# EAGLE design MCS (EAGLE 7.5.0)

## Sheet 1 of 2
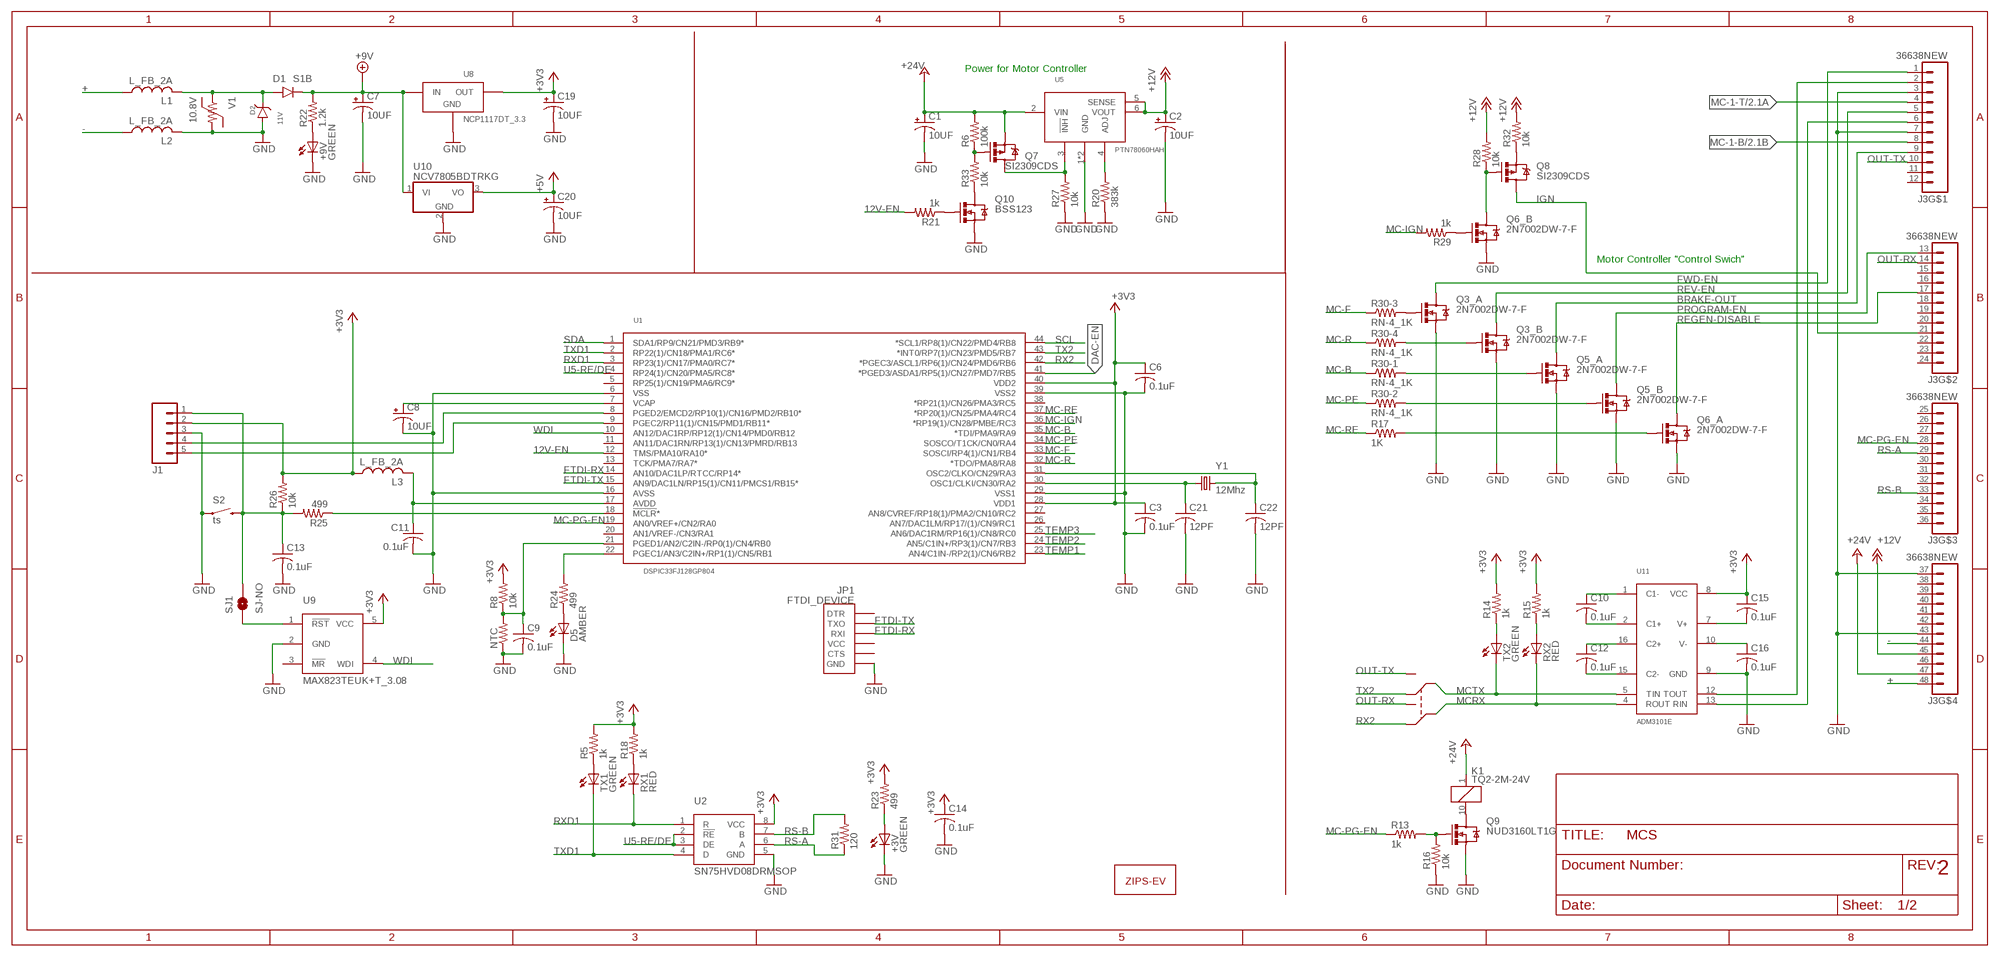
[diagram p0: schematic, sheet 1]

### Parts
+3V  GREEN  LED_GREEN  [CHIP_LED0805]
+9V  GREEN  LED_GREEN  [CHIP_LED0805]
C1  10UF  CAP-POL_10UF_60V  [EIA7343]
C2  10UF  CAP-POL_10UF_60V  [EIA7343]
C3  0.1uF  CAP_0.1UF_50V_0805  [0805]
C6  0.1uF  CAP_0.1UF_50V_0805  [0805]
C7  10UF  CAP-POL_10UF_16V  [EIA3216-16V]
C8  10UF  CAP-POL_10UF_16V  [EIA3216-16V]
C9  0.1uF  CAP_0.1UF_50V_0805  [0805]
C10  0.1uF  CAP_0.1UF_50V_0805  [0805]
C11  0.1uF  CAP_0.1UF_50V_0805  [0805]
C12  0.1uF  CAP_0.1UF_50V_0805  [0805]
C13  0.1uF  CAP_0.1UF_50V_0805  [0805]
C14  0.1uF  CAP_0.1UF_50V_0805  [0805]
C15  0.1uF  CAP_0.1UF_50V_0805  [0805]
C16  0.1uF  CAP_0.1UF_50V_0805  [0805]
C19  10UF  CAP-POL_10UF_16V  [EIA3216-16V]
C20  10UF  CAP-POL_10UF_16V  [EIA3216-16V]
C21  12PF  CAP_12PF_50V_0805  [0805]
C22  12PF  CAP_12PF_50V_0805  [0805]
D1  S1B  DIODE_S1B  [SMA]
D2  11V  DIODE-ZENER_11V  [SOD-123]
D5  AMBER  LED_AMBER  [CHIP_LED0805]
J1  M05LOCK_LONGPADS  [1X05_LOCK_LONGPADS]
J3  36638NEW  [36638-M]
JP1  FTDI_DEVICE  [FTDI_DEVICE_SIDE]
K1  TQ2-2M-24V  [TQ2-2M-24V]
L1  L_FB_2A  [0805]
L2  L_FB_2A  [0805]
L3  L_FB_2A  [0805]
NTC  RESISTOR0805-RES  [0805]
Q3  2N7002DW-7-F  [SOT-363]
Q5  2N7002DW-7-F  [SOT-363]
Q6  2N7002DW-7-F  [SOT-363]
Q7  SI2309CDS  MOS-P_SI2309CDS  [SOT23]
Q8  SI2309CDS  MOS-P_SI2309CDS  [SOT23]
Q9  NUD3160LT1G  [SOT23]
Q10  BSS123  MOS-N_BSS123  [SOT23]
R5  1k  RES_1K_1%_0805  [0805]
R6  100k  RES_1K_1%_0805  [0805]
R8  10k  RES_10K_1%_0805  [0805]
R13  1k  RES_1K_1%_0805  [0805]
R14  1k  RES_1K_1%_0805  [0805]
R15  1k  RES_1K_1%_0805  [0805]
R16  10k  RES_10K_1%_0805  [0805]
R17  1K  RES_1K_1%_0805  [0805]
R18  1k  RES_1K_1%_0805  [0805]
R20  383k  RES_383K_1%_0805  [0805]
R21  1k  RES_1K_1%_0805  [0805]
R22  1.2k  RES_1.2K_1%_0805  [0805]
R23  499  RES_499_1%_0805  [0805]
R24  499  RES_499_1%_0805  [0805]
R25  499  RES_499_1%_0805  [0805]
R26  10k  RES_10K_1%_0805  [0805]
R27  10k  RES_10K_1%_0805  [0805]
R28  10k  RES_10K_1%_0805  [0805]
R29  1k  RES_1K_1%_0805  [0805]
R30  RN-4_1K  [MNR14]
R31  120  RES_120_1%_0805  [0805]
R32  10k  RES_10K_1%_0805  [0805]
R33  10k  RES_10K_1%_0805  [0805]
RX1  RED  LED_RED  [CHIP_LED0805]
RX2  RED  LED_RED  [CHIP_LED0805]
S2  ts  SWITCH-MOMENTARY-2PTH  [TACTILE-PTH]
SJ1  SJ-NO  SOLDERJUMPERNO  [SJ_2S-NO]
TX1  GREEN  LED_GREEN  [CHIP_LED0805]
TX2  GREEN  LED_GREEN  [CHIP_LED0805]
U1  DSPIC33FJ128GP804  [TQFP-44]
U2  SN75HVD08DRMSOP  [MSOP-8]
U5  PTN78060HAH  [PTN78060HAH]
U8  NCP1117DT_3.3  [DPAK]
U9  MAX823TEUK+T_3.08  [SOT23-5]
U10  NCV7805BDTRKG  [DPAK]
U11  ADM3101E  [SSOP-16]
U$1  LOGO16-2-L  [2016-2-LOGO-L]
V1  10.8V  VARISTOR_10.8V  [0805]
Y1  12Mhz  CRYSTAL5X3  [CRYSTAL-SMD-5X3]

### Nets
12V-EN: R21.2 U1.12(TMS/PMA10/RA10*)
+: J3.48 L1.1
+3V3: C3.1(+) C6.1(+) C14.1(+) C15.1(+) C19.A(+) J1.2 L3.1 R5.2 R8.2 R14.2 R15.2 R18.2 R23.2 R26.2 U1.28(VDD1) U1.40(VDD2) U2.8(VCC) U8.2(OUT) U9.5(VCC) U11.8(VCC) ; also sheet 2
+5V: C20.A(+) U10.3(VO) ; also sheet 2
+9V: C7.A(+) D1.C R22.2 U8.3(IN) U10.1(VI)
+12V: C2.A(+) J3.45 R28.2 R32.2 U5.5(SENSE) U5.6(VOUT)
+24V: C1.A(+) J3.47 K1.1(+) Q7.2(S) R6.2 U5.2(VIN) ; also sheet 2
-: J3.44 L2.1
BOX_TEMP: C9.1(+) NTC.2 R8.1 U1.21(PGED1/AN2/C2IN-/RP0(1)/CN4/RB0)
BRAKE-OUT: J3.9 Q5.3(_A:D)
DAC-EN: U1.41(*PGED3/ASDA1/RP5(1)/CN27/PMD7/RB5) ; also sheet 2
FTDI-RX: JP1.P$3(RXI) U1.14(AN10/DAC1LP/RTCC/RP14*)
FTDI-TX: JP1.P$2(TXO) U1.15(AN9/DAC1LN/RP15(1)/CN11/PMCS1/RB15*)
FWD-EN: J3.1 Q3.3(_A:D)
GND: +3V.C +9V.C C1.C(-) C2.C(-) C3.2(-) C6.2(-) C7.C(-) C8.C(-) C9.2(-) C11.2(-) C13.2(-) C14.2(-) C16.2(-) C19.C(-) C20.C(-) C21.2(-) C22.2(-) D2.A D5.C J1.3 J3.3 J3.7 J3.37 J3.43 JP1.P$6(GND) L2.2 NTC.1 Q3.1(_B:S) Q3.4(_A:S) Q5.1(_B:S) Q5.4(_A:S) Q6.1(_B:S) Q6.4(_A:S) Q9.2(S) Q10.2(S) R16.1 R20.1 R27.1 S2.1 U1.6(VSS) U1.16(AVSS) U1.29(VSS1) U1.39(VSS2) U2.5(GND) U5.1(GND) U5.7(GND) U8.1(GND) U9.2(GND) U10.2(GND) U11.9(GND) V1.2 ; also sheet 2
IGN: J3.21 Q8.3(D)
MC-1-B: J3.8 ; also sheet 2
MC-1-T: J3.4 ; also sheet 2
MC-B: R30.1 U1.35(*TDI/PMA9/RA9)
MC-F: R30.3 U1.33(SOSCI/RP4(1)/CN1/RB4)
MC-IGN: R29.2 U1.36(*RP19(1)/CN28/PMBE/RC3)
MC-PE: R30.2 U1.34(SOSCO/T1CK/CN0/RA4)
MC-PG-EN: J3.28 R13.1 U1.19(AN0/VREF+/CN2/RA0)
MC-R: R30.4 U1.32(*TDO/PMA8/RA8)
MC-RE: R17.1 U1.37(*RP20(1)/CN25/PMA4/RC4)
MCRX: K1.3(C1) RX2.C U11.4(ROUT)
MCTX: K1.8(C2) TX2.C U11.5(TIN)
N$1: C13.1(+) J1.1 R25.2 R26.1 S2.3 SJ1.2
N$2: C11.1(+) L3.2 U1.17(AVDD)
N$4: C8.A(+) U1.7(VCAP)
N$5: R24.2 U1.22(PGEC1/AN3/C2IN+/RP1(1)/CN5/RB1)
N$6: +9V.A R22.1
N$7: Q3.5(_A:G) R30.6
N$8: R25.1 U1.18(!MCLR!*)
N$9: R5.1 TX1.A
N$10: SJ1.1 U9.1(!RST)
N$11: R18.1 RX1.A
N$12: J1.4 U1.8(PGED2/EMCD2/RP10(1)/CN16/PMD2/RB10*)
N$13: +3V.A R23.1
N$14: Q7.1(G) R6.1 R33.2
N$15: J1.5 U1.9(PGEC2/RP11(1)/CN15/PMD1/RB11*)
N$16: Q6.6(_B:D) Q8.1(G) R28.1
N$19: Q6.2(_B:G) R29.1
N$20: Q3.2(_B:G) R30.5
N$23: Q7.3(D) R27.2 U5.3(!INH)
N$24: D5.A R24.1
N$26: K1.10(-) Q9.3(D)
N$27: Q10.1(G) R21.1
N$28: Q8.2(S) R32.1
N$29: Q5.5(_A:G) R30.8
N$30: Q10.3(D) R33.1
N$35: Q6.5(_A:G) R17.2
N$39: C22.1(+) U1.31(OSC2/CLKO/CN29/RA3) Y1.3
N$40: C21.1(+) U1.30(OSC1/CLKI/CN30/RA2) Y1.1
N$59: C10.1(+) U11.1(C1-)
N$63: D1.A D2.C L1.2 V1.1
N$65: C10.2(-) U11.2(C1+)
N$66: C12.1(+) U11.16(C2+)
N$67: C12.2(-) U11.15(C2-)
N$68: C15.2(-) U11.7(V+)
N$72: C16.1(+) U11.10(V-)
N$73: J3.2 U11.12(TOUT)
N$74: J3.6 U11.13(RIN)
N$75: R15.1 RX2.A
N$76: R14.1 TX2.A
N$78: Q9.1(G) R13.2 R16.2
N$79: R20.2 U5.4(ADJ)
N$81: Q5.2(_B:G) R30.7
OUT-RX: J3.14 K1.4(NO1)
OUT-TX: J3.10 K1.7(NO2)
PROGRAM-EN: J3.13 Q5.6(_B:D)
REGEN-DISABLE: J3.17 Q6.3(_A:D)
REV-EN: J3.5 Q3.6(_B:D)
RS-A: J3.29 R31.1 U2.6(A)
RS-B: J3.33 R31.2 U2.7(B)
RX2: K1.2(NC1) U1.42(*PGEC3/ASCL1/RP6(1)/CN24/PMD6/RB6)
RXD1: RX1.C U1.3(RP23(1)/CN17/PMA0/RC7*) U2.1(R)
SCL: U1.44(*SCL1/RP8(1)/CN22/PMD4/RB8) ; also sheet 2
SDA: U1.1(SDA1/RP9/CN21/PMD3/RB9*) ; also sheet 2
TEMP1: U1.23(AN4/C1IN-/RP2(1)/CN6/RB2)
TEMP2: U1.24(AN5/C1IN+/RP3(1)/CN7/RB3)
TEMP3: U1.25(AN6/DAC1RM/RP16(1)/CN8/RC0)
TX2: K1.9(NC2) U1.43(*INT0/RP7(1)/CN23/PMD5/RB7)
TXD1: TX1.C U1.2(RP22(1)/CN18/PMA1/RC6*) U2.4(D)
U5-RE/DE: U1.4(RP24(1)/CN20/PMA5/RC8*) U2.2(!RE) U2.3(DE)
WDI: U1.10(AN12/DAC1RP/RP12(1)/CN14/PMD0/RB12) U9.4(WDI)
Unconnected: J3.11 J3.12 J3.15 J3.16 J3.18 J3.19 J3.20 J3.22 J3.23 J3.24 J3.25 J3.26 J3.27 J3.30 J3.31 J3.32 J3.34 J3.35 J3.36 J3.38 J3.39 J3.40 J3.41 J3.42 J3.46 JP1.P$1(DTR) JP1.P$4(VCC) JP1.P$5(CTS) U1.5(RP25(1)/CN19/PMA6/RC9*) U1.11(AN11/DAC1RN/RP13(1)/CN13/PMRD/RB13) U1.13(TCK/PMA7/RA7*) U1.20(AN1/VREF-/CN3/RA1) U1.26(AN7/DAC1LM/RP17/(1)/CN9/RC1) U1.27(AN8/CVREF/RP18(1)/PMA2/CN10/RC2) U1.38(*RP21(1)/CN26/PMA3/RC5) U9.3(!MR)

### Notes on the sheet
- Power for Motor Controller
- Motor Controller "Control Swich"
- 2

## Sheet 2 of 2
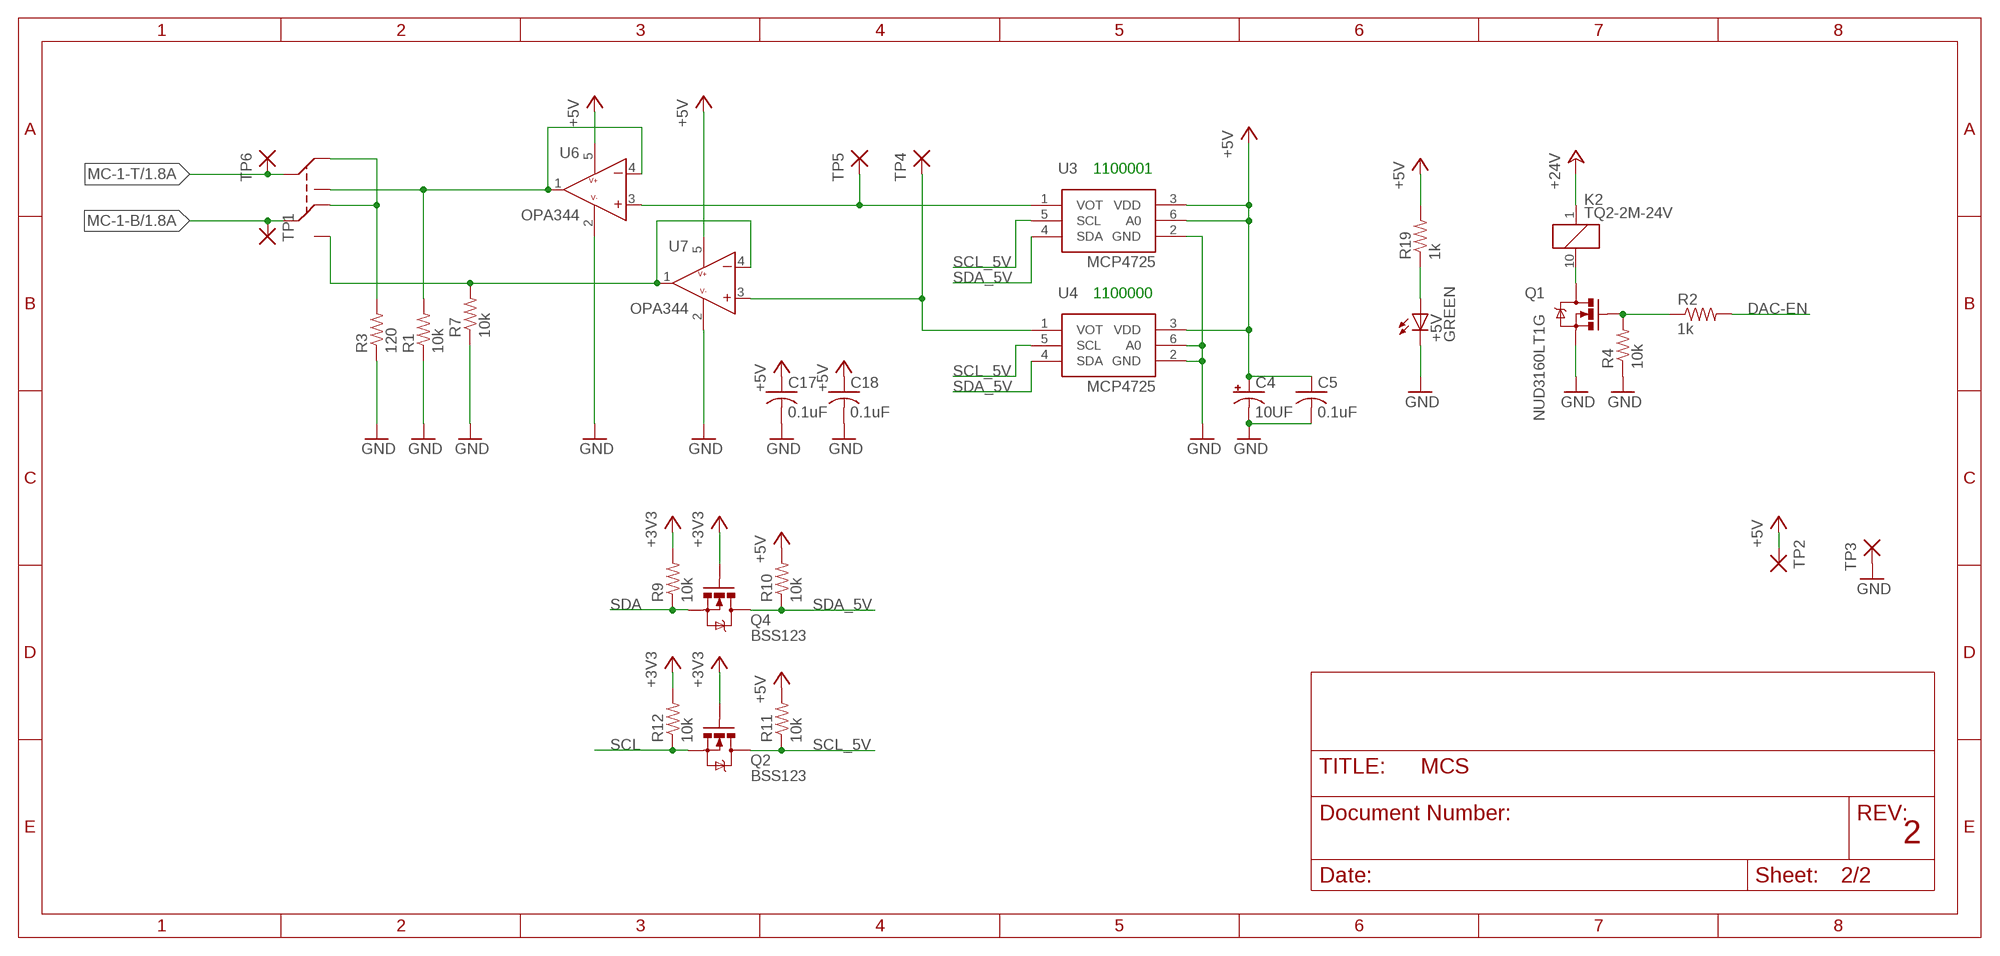
[diagram p1: schematic, sheet 2]

### Parts
+5V  GREEN  LED_GREEN  [CHIP_LED0805]
C4  10UF  CAP-POL_10UF_16V  [EIA3216-16V]
C5  0.1uF  CAP_0.1UF_50V_0805  [0805]
C17  0.1uF  CAP_0.1UF_50V_0805  [0805]
C18  0.1uF  CAP_0.1UF_50V_0805  [0805]
K2  TQ2-2M-24V  [TQ2-2M-24V]
Q1  NUD3160LT1G  [SOT23]
Q2  BSS123  MOS-N_BSS123  [SOT23]
Q4  BSS123  MOS-N_BSS123  [SOT23]
R1  10k  RES_10K_1%_0805  [0805]
R2  1k  RES_1K_1%_0805  [0805]
R3  120  RES_120_1%_0805  [0805]
R4  10k  RES_10K_1%_0805  [0805]
R7  10k  RES_10K_1%_0805  [0805]
R9  10k  RES_10K_1%_0805  [0805]
R10  10k  RES_10K_1%_0805  [0805]
R11  10k  RES_10K_1%_0805  [0805]
R12  10k  RES_10K_1%_0805  [0805]
R19  1k  RES_1K_1%_0805  [0805]
TP1  TP  [0603]
TP2  TP  [0603]
TP3  TP  [0603]
TP4  TP  [0603]
TP5  TP  [0603]
TP6  TP  [0603]
U3  MCP4725  [SOT23-6]
U4  MCP4725  [SOT23-6]
U6  OPA344  [SOT23-5]
U7  OPA344  [SOT23-5]

### Nets
+3V3: Q2.1(G) Q4.1(G) R9.2 R12.2 ; also sheet 1
+5V: C4.A(+) C5.1(+) C17.1(+) C18.1(+) R10.2 R11.2 R19.2 TP2.1 TP2.2 U3.3(VDD) U3.6(A0) U4.3(VDD) U6.5(V+) U7.5(V+) ; also sheet 1
+24V: K2.1(+) ; also sheet 1
DAC-EN: R2.2 ; also sheet 1
GND: +5V.C C4.C(-) C5.2(-) C17.2(-) C18.2(-) Q1.2(S) R1.1 R3.1 R4.1 R7.1 TP3.1 TP3.2 U3.2(GND) U4.2(GND) U4.6(A0) U6.2(V-) U7.2(V-) ; also sheet 1
MC-1-B: K2.8(C2) TP1.1 TP1.2 ; also sheet 1
MC-1-T: K2.3(C1) TP6.1 TP6.2 ; also sheet 1
N$3: K2.7(NO2) R7.2 U7.1(O) U7.4(-)
N$17: TP5.1 TP5.2 U3.1(VOT) U6.3(+)
N$18: K2.4(NO1) R1.2 U6.1(O) U6.4(-)
N$21: K2.2(NC1) K2.9(NC2) R3.2
N$22: TP4.1 TP4.2 U4.1(VOT) U7.3(+)
N$25: K2.10(-) Q1.3(D)
N$41: +5V.A R19.1
N$42: Q1.1(G) R2.1 R4.2
SCL: Q2.2(S) R12.1 ; also sheet 1
SCL_5V: Q2.3(D) R11.1 U3.5(SCL) U4.5(SCL)
SDA: Q4.2(S) R9.1 ; also sheet 1
SDA_5V: Q4.3(D) R10.1 U3.4(SDA) U4.4(SDA)

### Notes on the sheet
- 1100001
- 1100000
- 2

## Library data of the parts
+3V +5V +9V TX1 TX2 = FSAE Electric:LED; PARTNO: LTST-S220GKT
C1 C2 = FSAE Electric:CAP-POL; PARTNO: 293D106X9050E2TE3
C3 C5 C6 C9-C18 = FSAE Electric:CAP; PARTNO: CC0805ZRY5V9BB104
C4 C7 C8 C19 C20 = FSAE Electric:CAP-POL; PARTNO: T491A106M016AT
C21 C22 = FSAE Electric:CAP; PARTNO: CL21C120JBANNNC
D1 = FSAE Electric:DIODE: Diodes; PARTNO: S1B
D2 = FSAE Electric:DIODE-ZENER: Zener Diodes; PARTNO: NZH11C,115
D5 = FSAE Electric:LED; PARTNO: HSMA-C170
J1 = SparkFun-Connectors:M05: Header 5 Standard 5-pin 0.1" header. Use with straight break away headers (SKU : PRT-00116), right angle break away headers (PRT-00553), swiss pins (PRT-00743), machine pins (PRT-00117), and female headers (PRT-00115). Molex polarized connector foot print use with SKU : PRT-08230 with associated crimp pins and housings.
J3 = FSAE Electric:36638
JP1 = SparkFun-Connectors:FTDI_DEVICE: Connector which mates to FTDI basic or FTDI cable.
K1 K2 = FSAE Electric:TQ2-2M-24V; PARTNO: TQ2-2M-24V
L1-L3 = FSAE Electric:L; PARTNO: FBMH2012HM121-T
NTC = SparkFun-Passives:RESISTOR: Resistor Basic schematic elements and footprints for 0603, 1206, and PTH resistors.
Q1 Q9 = FSAE Electric:NUD3160LT1G; PARTNO: NUD3160LT1G
Q2 Q4 Q10 = FSAE Electric:MOS-N: N-Channel Mosfets; PARTNO: BSS123,215
Q3 Q5 Q6 = FSAE Electric:2N7002DW-7-F; PARTNO: 2N7002DW-7-F
Q7 Q8 = FSAE Electric:MOS-P; PARTNO: SI2309CDS-T1-GE3
R1 R4 R7-R12 R16 R26-R28 R32 R33 = FSAE Electric:RES: Resistors; PARTNO: RC0805FR-0710KL
R2 R5 R13-R15 R18 R19 R21 R29 = FSAE Electric:RES: Resistors; PARTNO: RC0805FR-071KL
R3 R31 = FSAE Electric:RES: Resistors; PARTNO: RC0805FR-07120RL
R6 R17 = FSAE Eletric:RES; PARTNO: RC0805FR-071KL
R20 = FSAE Eletric:RES; PARTNO: RC0805FR-07383KL
R22 = FSAE Electric:RES: Resistors; PARTNO: RC0805FR-071K2L
R23-R25 = FSAE Electric:RES: Resistors; PARTNO: RC0805FR-07499RL
R30 = FSAE Electric:RN-4; PARTNO: MNR14ERAPJ102
RX1 RX2 = FSAE Electric:LED; PARTNO: LH R974-LP-1
S2 = SparkFun-Electromechanical:SWITCH-MOMENTARY-2: Various NO switches- pushbuttons, reed, etc
SJ1 = SparkFun-Passives:SOLDERJUMPER: Solder Jumper Standard SMD solder jumper. Used to automate production. Two varients : Normally Open and Normally Closed are the same, but have different paste layers. NC will have a large amount of paste and should jumper during reflow.
TP1-TP6 = FSAE Electric:TP: SMD test points to make life easy to test / debug; PARTNO: 1625854-3
U1 = FSAE Electric:DSPIC33FJ128GP804; PARTNO: DSPIC33FJ128GP804-I/PT
U2 = FSAE Electric:SN75HVD08DR: RS485 Transceiver View on DigiKey <http://www.digikey.com/product-detail/en/SN75HVD08DR/296-37893-1-ND/4899996>; PARTNO: ISL83072EIUZA-T
U3 U4 = FSAE Electric:MCP4725: IC DAC 12BIT EE W/I2C SOT23-6; PARTNO: MCP4725A2T-E/CH
U5 = FSAE Electric:PTN78060HAH: REG SW 11.85-22V 3A HORZ T/H; PARTNO: PTN78060HAH
U6 U7 = FSAE Electric:OPA344; PARTNO: OPA344NA/3K
U8 = FSAE Electric:NCP1117DT; PARTNO: NCP1117DT33RKG
U9 = FSAE Electric:MAX823: IC SUPERV MPU CIRC SOT-23-5; PARTNO: MAX823TEUK+T
U10 = FSAE Electric:NCV7805BDTRKG; PARTNO: NCV7805BDTRKG
U11 = FSAE Electric:ADM3101E: IC TXRX RS-232 3.3V 15KV 16QSOP; PARTNO: ADM3101EARQZ-REEL
U$1 = Pic:LOGO
V1 = FSAE Electric:VARISTOR; PARTNO: VCAS080509A200DP
Y1 = SparkFun-FreqCtrl:CRYSTAL: Various standard crystals. Proven footprints. Spark Fun Electronics SKU : COM-00534

## Board
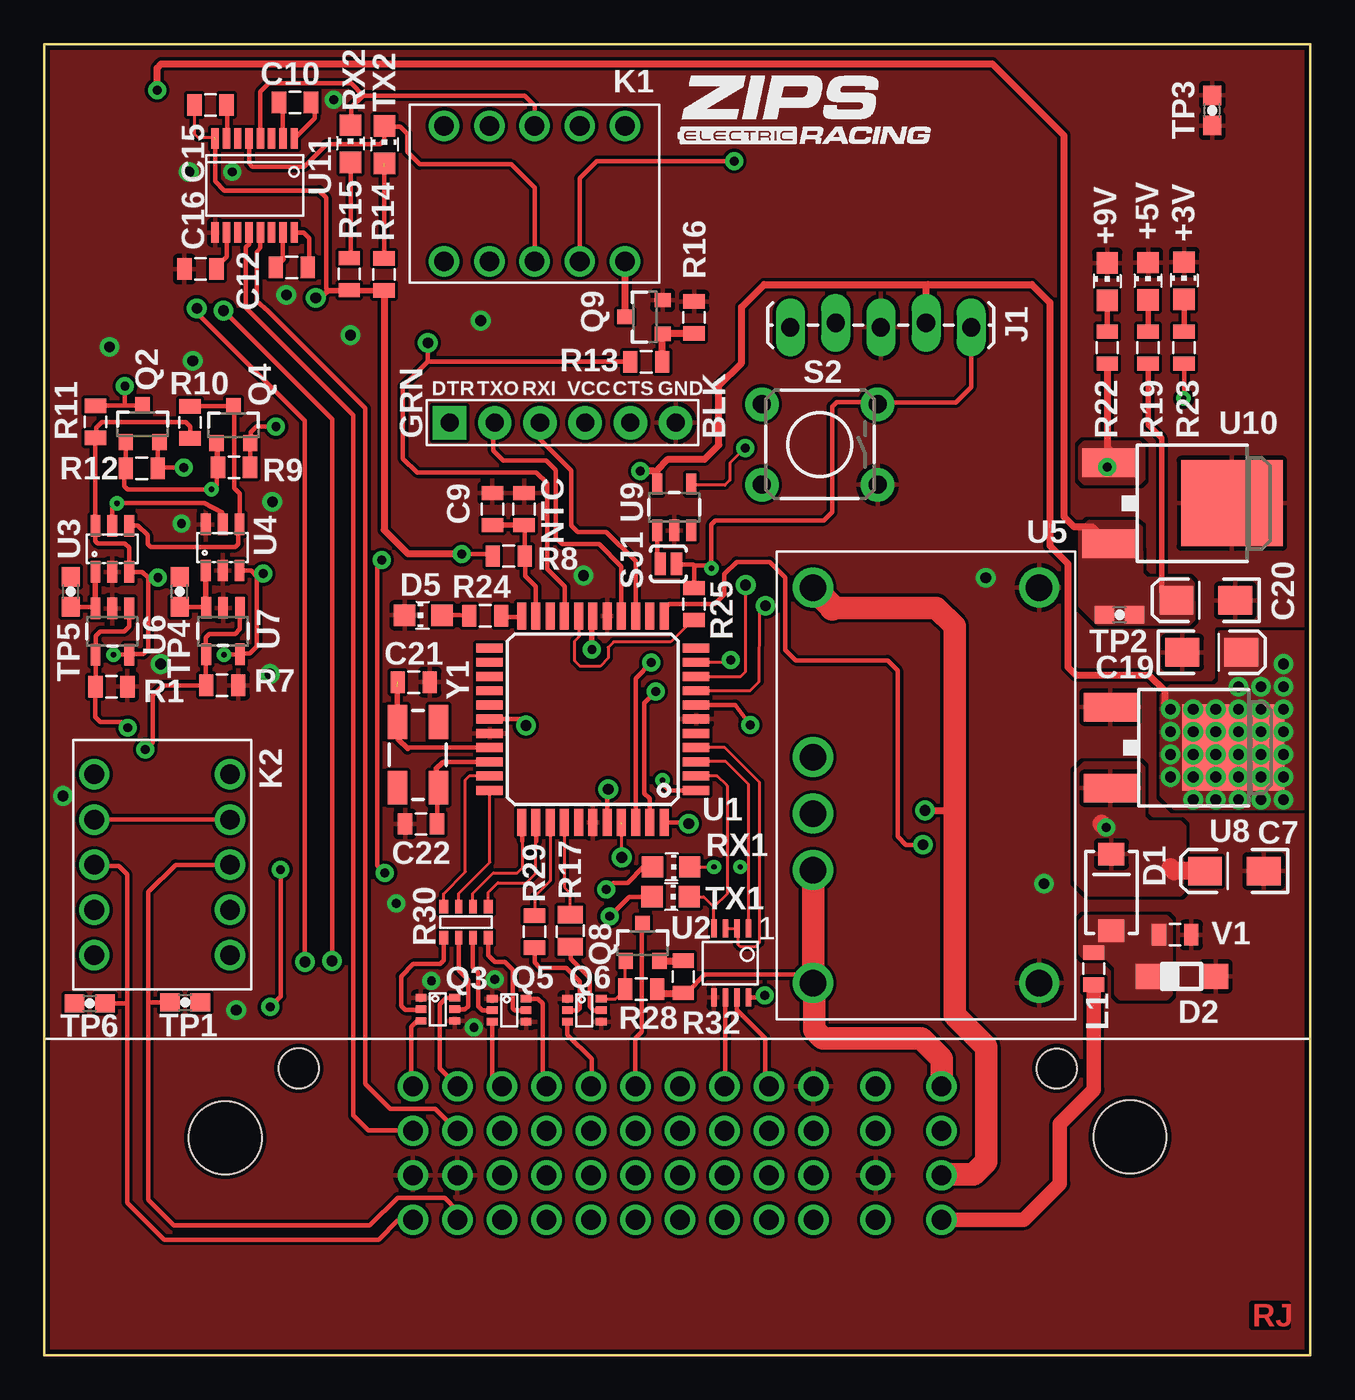
[diagram p2: board, top side]